# EasyEDA Pro project Designs.eprj, schematic Schematic10
Board Name: InstructionDecoder; Create Date: 2026-05-10; Page Name: P1; Project Name: Designs; Schematic Name: Schematic10; Update Date: 2026-05-10; Company: EasyEDA.com; Page Size: A4; Version: V1.0
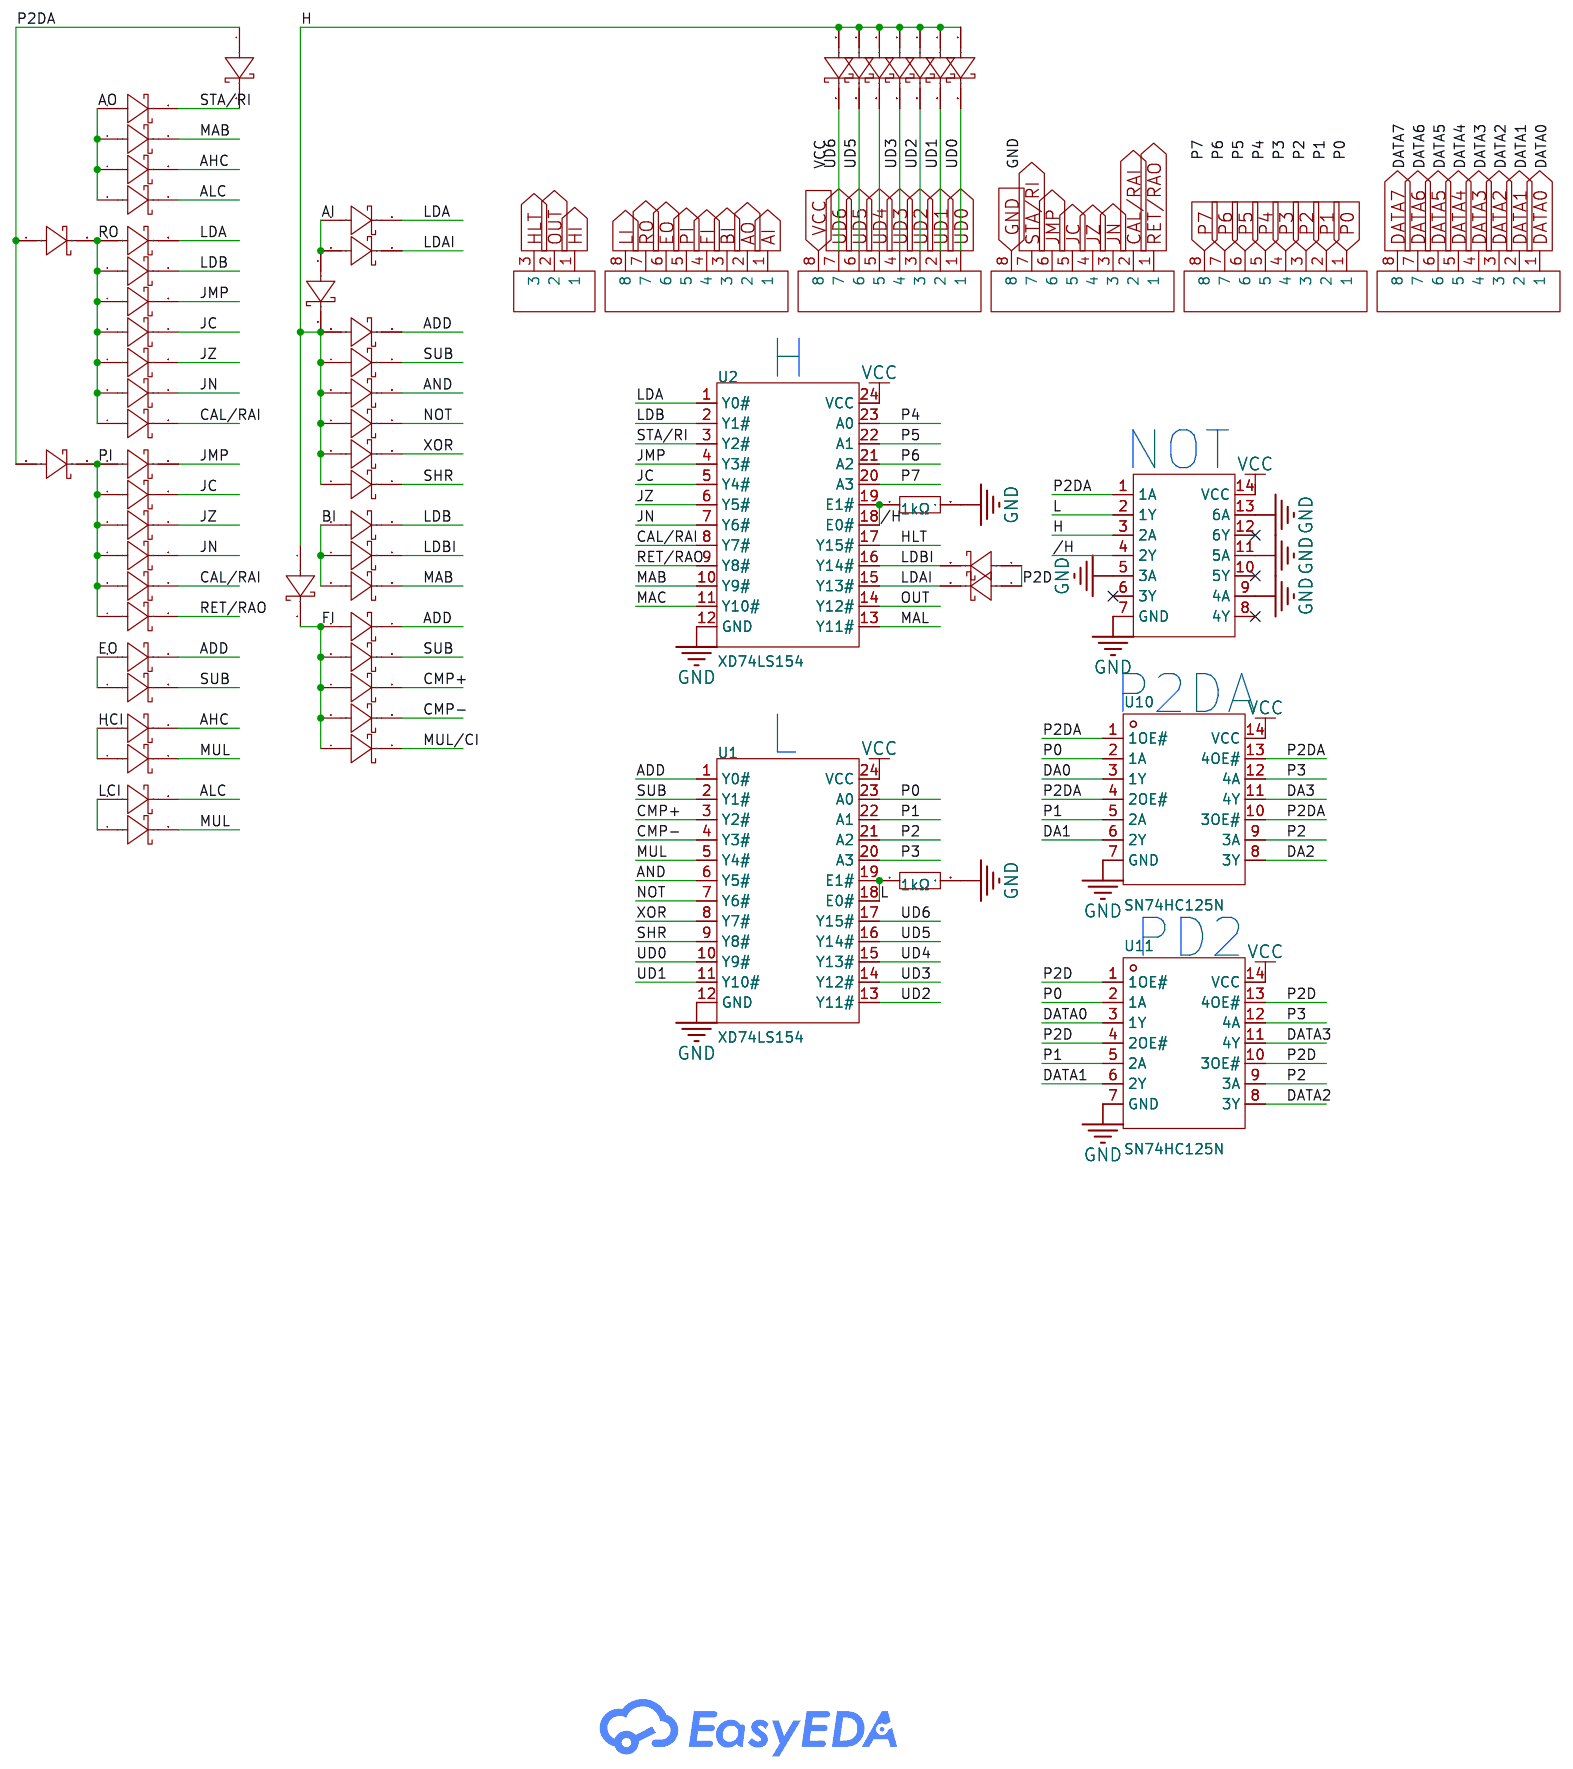
[diagram p7: schematic sheet]

## Parts
R60  1kΩ  [RES-TH_BD2.3-L6.5-P10.50-D0.5]
R61  1kΩ  [RES-TH_BD2.3-L6.5-P10.50-D0.5]
U1  XD74LS154  [DIP-24_L32.0-W13.8-P2.54-LS15.6-BL]
U2  XD74LS154  [DIP-24_L32.0-W13.8-P2.54-LS15.6-BL]
U10  SN74HC125N  [PDIP-14_L19.3-W6.4-P2.54-LS7.6-BL]
U11  SN74HC125N  [PDIP-14_L19.3-W6.4-P2.54-LS7.6-BL]
U210  SN74HC04N(LX)  [DIP-14_L19.6-W6.4-P2.54-LS7.6-BL]
U414  1N4007-DIODE  [DO-41_BD2.4-L4.7-P8.70-D0.8-FD]
U415  1N4007-DIODE  [DO-41_BD2.4-L4.7-P8.70-D0.8-FD]
U416  1N4007-DIODE  [DO-41_BD2.4-L4.7-P8.70-D0.8-FD]
U417  1N4007-DIODE  [DO-41_BD2.4-L4.7-P8.70-D0.8-FD]
U418  1N4007-DIODE  [DO-41_BD2.4-L4.7-P8.70-D0.8-FD]
U419  1N4007-DIODE  [DO-41_BD2.4-L4.7-P8.70-D0.8-FD]
U420  1N4007-DIODE  [DO-41_BD2.4-L4.7-P8.70-D0.8-FD]
U421  1N4007-DIODE  [DO-41_BD2.4-L4.7-P8.70-D0.8-FD]
U422  1N4007-DIODE  [DO-41_BD2.4-L4.7-P8.70-D0.8-FD]
U423  1N4007-DIODE  [DO-41_BD2.4-L4.7-P8.70-D0.8-FD]
U424  1N4007-DIODE  [DO-41_BD2.4-L4.7-P8.70-D0.8-FD]
U425  1N4007-DIODE  [DO-41_BD2.4-L4.7-P8.70-D0.8-FD]
U426  1N4007-DIODE  [DO-41_BD2.4-L4.7-P8.70-D0.8-FD]
U427  1N4007-DIODE  [DO-41_BD2.4-L4.7-P8.70-D0.8-FD]
U428  1N4007-DIODE  [DO-41_BD2.4-L4.7-P8.70-D0.8-FD]
U429  1N4007-DIODE  [DO-41_BD2.4-L4.7-P8.70-D0.8-FD]
U430  1N4007-DIODE  [DO-41_BD2.4-L4.7-P8.70-D0.8-FD]
U431  1N4007-DIODE  [DO-41_BD2.4-L4.7-P8.70-D0.8-FD]
U432  1N4007-DIODE  [DO-41_BD2.4-L4.7-P8.70-D0.8-FD]
U433  1N4007-DIODE  [DO-41_BD2.4-L4.7-P8.70-D0.8-FD]
U434  1N4007-DIODE  [DO-41_BD2.4-L4.7-P8.70-D0.8-FD]
U435  1N4007-DIODE  [DO-41_BD2.4-L4.7-P8.70-D0.8-FD]
U436  1N4007-DIODE  [DO-41_BD2.4-L4.7-P8.70-D0.8-FD]
U437  1N4007-DIODE  [DO-41_BD2.4-L4.7-P8.70-D0.8-FD]
U438  1N4007-DIODE  [DO-41_BD2.4-L4.7-P8.70-D0.8-FD]
U439  1N4007-DIODE  [DO-41_BD2.4-L4.7-P8.70-D0.8-FD]
U440  1N4007-DIODE  [DO-41_BD2.4-L4.7-P8.70-D0.8-FD]
U441  1N4007-DIODE  [DO-41_BD2.4-L4.7-P8.70-D0.8-FD]
U442  1N4007-DIODE  [DO-41_BD2.4-L4.7-P8.70-D0.8-FD]
U443  1N4007-DIODE  [DO-41_BD2.4-L4.7-P8.70-D0.8-FD]
U444  1N4007-DIODE  [DO-41_BD2.4-L4.7-P8.70-D0.8-FD]
U445  1N4007-DIODE  [DO-41_BD2.4-L4.7-P8.70-D0.8-FD]
U446  1N4007-DIODE  [DO-41_BD2.4-L4.7-P8.70-D0.8-FD]
U447  1N4007-DIODE  [DO-41_BD2.4-L4.7-P8.70-D0.8-FD]
U448  1N4007-DIODE  [DO-41_BD2.4-L4.7-P8.70-D0.8-FD]
U449  1N4007-DIODE  [DO-41_BD2.4-L4.7-P8.70-D0.8-FD]
U450  TH2.54_8P_0.6  [HDR-TH_8P-P2.54-V-M-3]
U451  TH2.54_8P_0.6  [HDR-TH_8P-P2.54-V-M-3]
U452  TH2.54_8P_0.6  [HDR-TH_8P-P2.54-V-M-3]
U453  TH2.54_8P_0.6  [HDR-TH_8P-P2.54-V-M-3]
U454  TH2.54_8P_0.6  [HDR-TH_8P-P2.54-V-M-3]
U455  HEAD3  [HDR-TH_3P-P2.54-V-M-2]
U456  1N4007-DIODE  [DO-41_BD2.4-L4.7-P8.70-D0.8-FD]
U457  1N4007-DIODE  [DO-41_BD2.4-L4.7-P8.70-D0.8-FD]
U458  1N4007-DIODE  [DO-41_BD2.4-L4.7-P8.70-D0.8-FD]
U459  1N4007-DIODE  [DO-41_BD2.4-L4.7-P8.70-D0.8-FD]
U461  1N4007-DIODE  [DO-41_BD2.4-L4.7-P8.70-D0.8-FD]
U462  1N4007-DIODE  [DO-41_BD2.4-L4.7-P8.70-D0.8-FD]
U463  1N4007-DIODE  [DO-41_BD2.4-L4.7-P8.70-D0.8-FD]
U464  1N4007-DIODE  [DO-41_BD2.4-L4.7-P8.70-D0.8-FD]
U465  1N4007-DIODE  [DO-41_BD2.4-L4.7-P8.70-D0.8-FD]
U466  1N4007-DIODE  [DO-41_BD2.4-L4.7-P8.70-D0.8-FD]
U470  1N4007-DIODE  [DO-41_BD2.4-L4.7-P8.70-D0.8-FD]
U471  1N4007-DIODE  [DO-41_BD2.4-L4.7-P8.70-D0.8-FD]
U472  1N4007-DIODE  [DO-41_BD2.4-L4.7-P8.70-D0.8-FD]
U473  1N4007-DIODE  [DO-41_BD2.4-L4.7-P8.70-D0.8-FD]
U474  1N4007-DIODE  [DO-41_BD2.4-L4.7-P8.70-D0.8-FD]
U475  1N4007-DIODE  [DO-41_BD2.4-L4.7-P8.70-D0.8-FD]
U476  1N4007-DIODE  [DO-41_BD2.4-L4.7-P8.70-D0.8-FD]

## Library data of the parts
R60 R61 = MF1/4W-1KΩ±1%T52: Type:Metal Film Resistors Resistance: Tolerance:±1% Tolerance:±1% Power(Watts):250mW Temperature Coefficient:±200ppm/℃ Temperature Coefficient:±200ppm/℃; LCSC Part Name: 金属膜电阻 1kΩ ±1% 250mW; Supplier Part: C713997; Manufacturer: 华星机电; Supplier Footprint: 插件,D2.3xL6.5mm; JLCPCB Part Class: Extended Part; Datasheet: https://atta.szlcsc.com/upload/public/pdf/source/20200731/C713882_AE8EB1102749D7E4FB4FB13DC898C429.pdf; Supplier: LCSC; Type: Metal Film Resistors; Tolerance: ±1%; Power(Watts): 250mW; Temperature Coefficient: ±200ppm/℃
U1 U2 = XD74LS154: LCSC Part Name: 编码器,解码器,复用器和解复用器; Supplier Part: C707077; Manufacturer: XINLUDA(信路达); Supplier Footprint: DIP-24; JLCPCB Part Class: Extended Part; Datasheet: https://item.szlcsc.com/datasheet/XD74LS154/744199.html; Supplier: LCSC; Type: Decoder; Voltage - Supply: 4.75V~5.25V; Number of lines: 4/16; Current - Output Low(IOL): 8mA; Current - Output High(IOH): 400uA; Operating temperature: 0℃~+70℃; Propagation Delay: 23ns；19ns; Quiescent Current: 9mA
U10 U11 = SN74HC125N: LCSC Part Name: 三态输出，四路总线缓冲门; Supplier Part: C2890; Manufacturer: TI(德州仪器); Supplier Footprint: DIP-14; JLCPCB Part Class: Extended Part; Datasheet: https://www.ti.com/cn/lit/gpn/sn74hc125; Supplier: LCSC; output type: Tri-State; Voltage - Supply: 2V~6V; Number of Elements: 4; Number of Bits per Element: 1; Channel Type: Unidirectional; Current - Output Low(IOL): 7.8mA; Current - Output High(IOH): 7.8mA; Logic Family: 74HC; Operating Temperature: -40℃~+85℃; Quiescent Current: 80uA; Propagation Delay: 24ns@4.5V,50pF
U210 = SN74HC04N(LX): LCSC Part Name: 集成电路; Supplier Part: C22436641; Manufacturer: LX(灵星芯微); Supplier Footprint: DIP-14; JLCPCB Part Class: Extended Part; Datasheet: https://item.szlcsc.com/datasheet/SN74HC04N(LX)/24070577.html; Supplier: LCSC; Voltage - Supply: 2V~6V; Quiescent Current(Iq): 2uA; Number of Circuits: 6; Input Logic Level - High: 1.5V~4.2V; Input Logic Level -Low: 500mV~1.8V; Output Logic Level - High: 4.4V；5.9V；1.9V; Output Logic Level - Low: 260mV；260mV；100mV; Propagation Delay: 14ns@6V,50pF; Series: 74HC Series; Operating Temperature: -40℃~+125℃
U414-U449 U456-U459 U461-U466 U470-U476 = 1N4007-DIODE: Supplier Part: C9900005663; Supplier Footprint: DO-41; JLCPCB Part Class: Extended Part; Supplier: LCSC
U450-U454 = TH2.54_8P_0.6: Supplier Part: C9900018349; Supplier Footprint: HDR-TH-8P; JLCPCB Part Class: Extended Part; Supplier: LCSC
U455 = HEAD3: Supplier Part: C9900010031; Supplier Footprint: HDR-TH_3P-P2.54; JLCPCB Part Class: Extended Part; Supplier: LCSC

## Nets
GND: R60.2 R61.2 U1.12(GND) U2.12(GND) U10.7(GND) U11.7(GND) U210.5(3A) U210.7(GND) U210.9(4A) U210.11(5A) U210.13(6A) U451.8
VCC: U1.24(VCC) U2.24(VCC) U10.14(VCC) U11.14(VCC) U210.14(VCC) U453.8
/H: R61.1 U2.18(E0#) U2.19(E1#) U210.4(2Y)
ADD: U1.1(Y0#) U418.2(K) U427.2(K) U448.2(K)
AHC: U434.2(K) U473.2(K)
AI: U416.1(A) U417.1(A) U454.1 U459.1(A)
ALC: U472.2(K) U475.2(K)
AND: U1.6(Y5#) U420.2(K)
AO: U432.1(A) U433.1(A) U434.1(A) U454.2 U472.1(A)
BI: U424.1(A) U425.1(A) U426.1(A) U454.3
CAL/RAI: U2.8(Y7#) U441.2(K) U446.2(K) U451.2
CMP+: U1.3(Y2#) U429.2(K)
CMP-: U1.4(Y3#) U430.2(K)
DA0: U10.3(1Y)
DA1: U10.6(2Y)
DA2: U10.8(3Y)
DA3: U10.11(4Y)
DATA0: U11.3(1Y) U452.1
DATA1: U11.6(2Y) U452.2
DATA2: U11.8(3Y) U452.3
DATA3: U11.11(4Y) U452.4
DATA4: U452.5
DATA5: U452.6
DATA6: U452.7
DATA7: U452.8
EO: U448.1(A) U449.1(A) U454.6
FI: U427.1(A) U428.1(A) U429.1(A) U430.1(A) U431.1(A) U454.4 U461.2(K)
H: U210.3(2A) U418.1(A) U419.1(A) U420.1(A) U421.1(A) U422.1(A) U423.1(A) U459.2(K) U461.1(A) U462.1(A) U463.1(A) U464.1(A) U465.1(A) U466.1(A) U470.1(A) U471.1(A)
HCI: U473.1(A) U474.1(A)
HI: U455.1
HLT: U2.17(Y15#) U455.3
JC: U2.5(Y4#) U438.2(K) U443.2(K) U451.5
JMP: U2.4(Y3#) U437.2(K) U442.2(K) U451.6
JN: U2.7(Y6#) U440.2(K) U445.2(K) U451.3
JZ: U2.6(Y5#) U439.2(K) U444.2(K) U451.4
L: R60.1 U1.18(E0#) U1.19(E1#) U210.2(1Y)
LCI: U475.1(A) U476.1(A)
LDA: U2.1(Y0#) U416.2(K) U435.2(K)
LDAI: U2.15(Y13#) U414.2(K) U417.2(K)
LDB: U2.2(Y1#) U424.2(K) U436.2(K)
LDBI: U2.16(Y14#) U415.2(K) U425.2(K)
LI: U454.8
MAB: U2.10(Y9#) U426.2(K) U433.2(K)
MAC: U2.11(Y10#)
MAL: U2.13(Y11#)
MUL: U1.5(Y4#) U474.2(K) U476.2(K)
MUL/CI: U431.2(K)
NOT: U1.7(Y6#) U421.2(K)
OUT: U2.14(Y12#) U455.2
P0: U1.23(A0) U10.2(1A) U11.2(1A) U450.1
P1: U1.22(A1) U10.5(2A) U11.5(2A) U450.2
P2: U1.21(A2) U10.9(3A) U11.9(3A) U450.3
P2D: U11.1(1OE#) U11.4(2OE#) U11.10(3OE#) U11.13(4OE#) U414.1(A) U415.1(A)
P2DA: U10.1(1OE#) U10.4(2OE#) U10.10(3OE#) U10.13(4OE#) U210.1(1A) U456.1(A) U457.1(A) U458.1(A)
P3: U1.20(A3) U10.12(4A) U11.12(4A) U450.4
P4: U2.23(A0) U450.5
P5: U2.22(A1) U450.6
P6: U2.21(A2) U450.7
P7: U2.20(A3) U450.8
PI: U442.1(A) U443.1(A) U444.1(A) U445.1(A) U446.1(A) U447.1(A) U454.5 U457.2(K)
RET/RAO: U2.9(Y8#) U447.2(K) U451.1
RO: U435.1(A) U436.1(A) U437.1(A) U438.1(A) U439.1(A) U440.1(A) U441.1(A) U454.7 U456.2(K)
SHR: U1.9(Y8#) U423.2(K)
STA/RI: U2.3(Y2#) U432.2(K) U451.7 U458.2(K)
SUB: U1.2(Y1#) U419.2(K) U428.2(K) U449.2(K)
UD0: U1.10(Y9#) U453.1 U470.2(K)
UD1: U1.11(Y10#) U453.2 U471.2(K)
UD2: U1.13(Y11#) U453.3 U462.2(K)
UD3: U1.14(Y12#) U453.4 U463.2(K)
UD4: U1.15(Y13#) U453.5 U464.2(K)
UD5: U1.16(Y14#) U453.6 U465.2(K)
UD6: U1.17(Y15#) U453.7 U466.2(K)
XOR: U1.8(Y7#) U422.2(K)

Not connected (* = marked no-connect by the designer): U210 6(3Y)* 8(4Y)* 10(5Y)* 12(6Y)*

## Notes on the sheet
- H
- NOT
- P2DA
- L
- PD2
